# EAGLE schematic Resistor_Resistor (EAGLE 8.3.0), part 26 of 43
## Parts (continued)
R35798  10K  RESISTOR_0201  [0201]
R35799  10K  RESISTOR_0201  [0201]
R35800  10K  RESISTOR_0201  [0201]
R35801  10K  RESISTOR_0201  [0201]
R35802  10K  RESISTOR_0201  [0201]
R35803  10K  RESISTOR_0201  [0201]
R35804  10K  RESISTOR_0201  [0201]
R35805  10K  RESISTOR_0201  [0201]
R35806  10K  RESISTOR_0201  [0201]
R35807  10K  RESISTOR_0201  [0201]
R35808  10K  RESISTOR_0201  [0201]
R35809  10K  RESISTOR_0201  [0201]
R35810  10K  RESISTOR_0201  [0201]
R35811  10K  RESISTOR_0201  [0201]
R35812  10K  RESISTOR_0201  [0201]
R35813  10K  RESISTOR_0201  [0201]
R35814  10K  RESISTOR_0201  [0201]
R35815  10K  RESISTOR_0201  [0201]
R35816  10K  RESISTOR_0201  [0201]
R35817  10K  RESISTOR_0201  [0201]
R35818  10K  RESISTOR_0201  [0201]
R35819  10K  RESISTOR_0201  [0201]
R35820  10K  RESISTOR_0201  [0201]
R35821  10K  RESISTOR_0201  [0201]
R35822  10K  RESISTOR_0201  [0201]
R35823  10K  RESISTOR_0201  [0201]
R35824  10K  RESISTOR_0201  [0201]
R35825  10K  RESISTOR_0201  [0201]
R35826  10K  RESISTOR_0201  [0201]
R35827  10K  RESISTOR_0201  [0201]
R35828  10K  RESISTOR_0201  [0201]
R35829  10K  RESISTOR_0201  [0201]
R35830  10K  RESISTOR_0201  [0201]
R35831  10K  RESISTOR_0201  [0201]
R35832  10K  RESISTOR_0201  [0201]
R35833  10K  RESISTOR_0201  [0201]
R35834  10K  RESISTOR_0201  [0201]
R35835  10K  RESISTOR_0201  [0201]
R35836  10K  RESISTOR_0201  [0201]
R35837  10K  RESISTOR_0201  [0201]
R35838  10K  RESISTOR_0201  [0201]
R35839  10K  RESISTOR_0201  [0201]
R35840  10K  RESISTOR_0201  [0201]
R35841  10K  RESISTOR_0201  [0201]
R35842  10K  RESISTOR_0201  [0201]
R35843  10K  RESISTOR_0201  [0201]
R35844  10K  RESISTOR_0201  [0201]
R35845  10K  RESISTOR_0201  [0201]
R35846  10K  RESISTOR_0201  [0201]
R35847  10K  RESISTOR_0201  [0201]
R35848  10K  RESISTOR_0201  [0201]
R35849  10K  RESISTOR_0201  [0201]
R35850  10K  RESISTOR_0201  [0201]
R35851  10K  RESISTOR_0201  [0201]
R35852  10K  RESISTOR_0201  [0201]
R35853  10K  RESISTOR_0201  [0201]
R35854  10K  RESISTOR_0201  [0201]
R35855  10K  RESISTOR_0201  [0201]
R35856  10K  RESISTOR_0201  [0201]
R35857  10K  RESISTOR_0201  [0201]
R35858  10K  RESISTOR_0201  [0201]
R35859  10K  RESISTOR_0201  [0201]
R35860  10K  RESISTOR_0201  [0201]
R35861  10K  RESISTOR_0201  [0201]
R35862  10K  RESISTOR_0201  [0201]
R35863  10K  RESISTOR_0201  [0201]
R35864  10K  RESISTOR_0201  [0201]
R35865  10K  RESISTOR_0201  [0201]
R35866  10K  RESISTOR_0201  [0201]
R35867  10K  RESISTOR_0201  [0201]
R35868  10K  RESISTOR_0201  [0201]
R35869  10K  RESISTOR_0201  [0201]
R35870  10K  RESISTOR_0201  [0201]
R35871  10K  RESISTOR_0201  [0201]
R35872  10K  RESISTOR_0201  [0201]
R35873  10K  RESISTOR_0201  [0201]
R35874  10K  RESISTOR_0201  [0201]
R35875  10K  RESISTOR_0201  [0201]
R35876  10K  RESISTOR_0201  [0201]
R35877  10K  RESISTOR_0201  [0201]
R35878  10K  RESISTOR_0201  [0201]
R35879  10K  RESISTOR_0201  [0201]
R35880  10K  RESISTOR_0201  [0201]
R35881  10K  RESISTOR_0201  [0201]
R35882  10K  RESISTOR_0201  [0201]
R35883  10K  RESISTOR_0201  [0201]
R35884  10K  RESISTOR_0201  [0201]
R35885  10K  RESISTOR_0201  [0201]
R35886  10K  RESISTOR_0201  [0201]
R35887  10K  RESISTOR_0201  [0201]
R35888  10K  RESISTOR_0201  [0201]
R35889  10K  RESISTOR_0201  [0201]
R35890  10K  RESISTOR_0201  [0201]
R35891  10K  RESISTOR_0201  [0201]
R35892  10K  RESISTOR_0201  [0201]
R35893  10K  RESISTOR_0201  [0201]
R35894  10K  RESISTOR_0201  [0201]
R35895  10K  RESISTOR_0201  [0201]
R35896  10K  RESISTOR_0201  [0201]
R35897  10K  RESISTOR_0201  [0201]
R35898  10K  RESISTOR_0201  [0201]
R35899  10K  RESISTOR_0201  [0201]
R35900  10K  RESISTOR_0201  [0201]
R35901  10K  RESISTOR_0201  [0201]
R35902  10K  RESISTOR_0201  [0201]
R35903  10K  RESISTOR_0201  [0201]
R35904  10K  RESISTOR_0201  [0201]
R35905  10K  RESISTOR_0201  [0201]
R35906  10K  RESISTOR_0201  [0201]
R35907  10K  RESISTOR_0201  [0201]
R35908  10K  RESISTOR_0201  [0201]
R35909  10K  RESISTOR_0201  [0201]
R35910  10K  RESISTOR_0201  [0201]
R35911  10K  RESISTOR_0201  [0201]
R35912  10K  RESISTOR_0201  [0201]
R35913  10K  RESISTOR_0201  [0201]
R35914  10K  RESISTOR_0201  [0201]
R35915  10K  RESISTOR_0201  [0201]
R35916  10K  RESISTOR_0201  [0201]
R35917  10K  RESISTOR_0201  [0201]
R35918  10K  RESISTOR_0201  [0201]
R35919  10K  RESISTOR_0201  [0201]
R35920  10K  RESISTOR_0201  [0201]
R35921  10K  RESISTOR_0201  [0201]
R35922  10K  RESISTOR_0201  [0201]
R35923  10K  RESISTOR_0201  [0201]
R35924  10K  RESISTOR_0201  [0201]
R35925  10K  RESISTOR_0201  [0201]
R35926  10K  RESISTOR_0201  [0201]
R35927  10K  RESISTOR_0201  [0201]
R35928  10K  RESISTOR_0201  [0201]
R35929  10K  RESISTOR_0201  [0201]
R35930  10K  RESISTOR_0201  [0201]
R35931  10K  RESISTOR_0201  [0201]
R35932  10K  RESISTOR_0201  [0201]
R35933  10K  RESISTOR_0201  [0201]
R35934  10K  RESISTOR_0201  [0201]
R35935  10K  RESISTOR_0201  [0201]
R35936  10K  RESISTOR_0201  [0201]
R35937  10K  RESISTOR_0201  [0201]
R35938  10K  RESISTOR_0201  [0201]
R35939  10K  RESISTOR_0201  [0201]
R35940  10K  RESISTOR_0201  [0201]
R35941  10K  RESISTOR_0201  [0201]
R35942  10K  RESISTOR_0201  [0201]
R35943  10K  RESISTOR_0201  [0201]
R35944  10K  RESISTOR_0201  [0201]
R35945  10K  RESISTOR_0201  [0201]
R35946  10K  RESISTOR_0201  [0201]
R35947  10K  RESISTOR_0201  [0201]
R35948  10K  RESISTOR_0201  [0201]
R35949  10K  RESISTOR_0201  [0201]
R35950  10K  RESISTOR_0201  [0201]
R35951  10K  RESISTOR_0201  [0201]
R35952  10K  RESISTOR_0201  [0201]
R35953  10K  RESISTOR_0201  [0201]
R35954  10K  RESISTOR_0201  [0201]
R35955  10K  RESISTOR_0201  [0201]
R35956  10K  RESISTOR_0201  [0201]
R35957  10K  RESISTOR_0201  [0201]
R35958  10K  RESISTOR_0201  [0201]
R35959  10K  RESISTOR_0201  [0201]
R35960  10K  RESISTOR_0201  [0201]
R35961  10K  RESISTOR_0201  [0201]
R35962  10K  RESISTOR_0201  [0201]
R35963  10K  RESISTOR_0201  [0201]
R35964  10K  RESISTOR_0201  [0201]
R35965  10K  RESISTOR_0201  [0201]
R35966  10K  RESISTOR_0201  [0201]
R35967  10K  RESISTOR_0201  [0201]
R35968  10K  RESISTOR_0201  [0201]
R35969  10K  RESISTOR_0201  [0201]
R35970  10K  RESISTOR_0201  [0201]
R35971  10K  RESISTOR_0201  [0201]
R35972  10K  RESISTOR_0201  [0201]
R35973  10K  RESISTOR_0201  [0201]
R35974  10K  RESISTOR_0201  [0201]
R35975  10K  RESISTOR_0201  [0201]
R35976  10K  RESISTOR_0201  [0201]
R35977  10K  RESISTOR_0201  [0201]
R35978  10K  RESISTOR_0201  [0201]
R35979  10K  RESISTOR_0201  [0201]
R35980  10K  RESISTOR_0201  [0201]
R35981  10K  RESISTOR_0201  [0201]
R35982  10K  RESISTOR_0201  [0201]
R35983  10K  RESISTOR_0201  [0201]
R35984  10K  RESISTOR_0201  [0201]
R35985  10K  RESISTOR_0201  [0201]
R35986  10K  RESISTOR_0201  [0201]
R35987  10K  RESISTOR_0201  [0201]
R35988  10K  RESISTOR_0201  [0201]
R35989  10K  RESISTOR_0201  [0201]
R35990  10K  RESISTOR_0201  [0201]
R35991  10K  RESISTOR_0201  [0201]
R35992  10K  RESISTOR_0201  [0201]
R35993  10K  RESISTOR_0201  [0201]
R35994  10K  RESISTOR_0201  [0201]
R35995  10K  RESISTOR_0201  [0201]
R35996  10K  RESISTOR_0201  [0201]
R35997  10K  RESISTOR_0201  [0201]
R35998  10K  RESISTOR_0201  [0201]
R35999  10K  RESISTOR_0201  [0201]
R36000  10K  RESISTOR_0201  [0201]
R36001  10K  RESISTOR_0201  [0201]
R36002  10K  RESISTOR_0201  [0201]
R36003  10K  RESISTOR_0201  [0201]
R36004  10K  RESISTOR_0201  [0201]
R36005  10K  RESISTOR_0201  [0201]
R36006  10K  RESISTOR_0201  [0201]
R36007  10K  RESISTOR_0201  [0201]
R36008  10K  RESISTOR_0201  [0201]
R36009  10K  RESISTOR_0201  [0201]
R36010  10K  RESISTOR_0201  [0201]
R36011  10K  RESISTOR_0201  [0201]
R36012  10K  RESISTOR_0201  [0201]
R36013  10K  RESISTOR_0201  [0201]
R36014  10K  RESISTOR_0201  [0201]
R36015  10K  RESISTOR_0201  [0201]
R36016  10K  RESISTOR_0201  [0201]
R36017  10K  RESISTOR_0201  [0201]
R36018  10K  RESISTOR_0201  [0201]
R36019  10K  RESISTOR_0201  [0201]
R36020  10K  RESISTOR_0201  [0201]
R36021  10K  RESISTOR_0201  [0201]
R36022  10K  RESISTOR_0201  [0201]
R36023  10K  RESISTOR_0201  [0201]
R36024  10K  RESISTOR_0201  [0201]
R36025  10K  RESISTOR_0201  [0201]
R36026  10K  RESISTOR_0201  [0201]
R36027  10K  RESISTOR_0201  [0201]
R36028  10K  RESISTOR_0201  [0201]
R36029  10K  RESISTOR_0201  [0201]
R36030  10K  RESISTOR_0201  [0201]
R36031  10K  RESISTOR_0201  [0201]
R36032  10K  RESISTOR_0201  [0201]
R36033  10K  RESISTOR_0201  [0201]
R36034  10K  RESISTOR_0201  [0201]
R36035  10K  RESISTOR_0201  [0201]
R36036  10K  RESISTOR_0201  [0201]
R36037  10K  RESISTOR_0201  [0201]
R36038  10K  RESISTOR_0201  [0201]
R36039  10K  RESISTOR_0201  [0201]
R36040  10K  RESISTOR_0201  [0201]
R36041  10K  RESISTOR_0201  [0201]
R36042  10K  RESISTOR_0201  [0201]
R36043  10K  RESISTOR_0201  [0201]
R36044  10K  RESISTOR_0201  [0201]
R36045  10K  RESISTOR_0201  [0201]
R36046  10K  RESISTOR_0201  [0201]
R36047  10K  RESISTOR_0201  [0201]
R36048  10K  RESISTOR_0201  [0201]
R36049  10K  RESISTOR_0201  [0201]
R36050  10K  RESISTOR_0201  [0201]
R36051  10K  RESISTOR_0201  [0201]
R36052  10K  RESISTOR_0201  [0201]
R36053  10K  RESISTOR_0201  [0201]
R36054  10K  RESISTOR_0201  [0201]
R36055  10K  RESISTOR_0201  [0201]
R36056  10K  RESISTOR_0201  [0201]
R36057  10K  RESISTOR_0201  [0201]
R36058  10K  RESISTOR_0201  [0201]
R36059  10K  RESISTOR_0201  [0201]
R36060  10K  RESISTOR_0201  [0201]
R36061  10K  RESISTOR_0201  [0201]
R36062  10K  RESISTOR_0201  [0201]
R36063  10K  RESISTOR_0201  [0201]
R36064  10K  RESISTOR_0201  [0201]
R36065  10K  RESISTOR_0201  [0201]
R36066  10K  RESISTOR_0201  [0201]
R36067  10K  RESISTOR_0201  [0201]
R36068  10K  RESISTOR_0201  [0201]
R36069  10K  RESISTOR_0201  [0201]
R36070  10K  RESISTOR_0201  [0201]
R36071  10K  RESISTOR_0201  [0201]
R36072  10K  RESISTOR_0201  [0201]
R36073  10K  RESISTOR_0201  [0201]
R36074  10K  RESISTOR_0201  [0201]
R36075  10K  RESISTOR_0201  [0201]
R36076  10K  RESISTOR_0201  [0201]
R36077  10K  RESISTOR_0201  [0201]
R36078  10K  RESISTOR_0201  [0201]
R36079  10K  RESISTOR_0201  [0201]
R36080  10K  RESISTOR_0201  [0201]
R36081  10K  RESISTOR_0201  [0201]
R36082  10K  RESISTOR_0201  [0201]
R36083  10K  RESISTOR_0201  [0201]
R36084  10K  RESISTOR_0201  [0201]
R36085  10K  RESISTOR_0201  [0201]
R36086  10K  RESISTOR_0201  [0201]
R36087  10K  RESISTOR_0201  [0201]
R36088  10K  RESISTOR_0201  [0201]
R36089  10K  RESISTOR_0201  [0201]
R36090  10K  RESISTOR_0201  [0201]
R36091  10K  RESISTOR_0201  [0201]
R36092  10K  RESISTOR_0201  [0201]
R36093  10K  RESISTOR_0201  [0201]
R36094  10K  RESISTOR_0201  [0201]
R36095  10K  RESISTOR_0201  [0201]
R36096  10K  RESISTOR_0201  [0201]
R36097  10K  RESISTOR_0201  [0201]
R36098  10K  RESISTOR_0201  [0201]
R36099  10K  RESISTOR_0201  [0201]
R36100  10K  RESISTOR_0201  [0201]
R36101  10K  RESISTOR_0201  [0201]
R36102  10K  RESISTOR_0201  [0201]
R36103  10K  RESISTOR_0201  [0201]
R36104  10K  RESISTOR_0201  [0201]
R36105  10K  RESISTOR_0201  [0201]
R36106  10K  RESISTOR_0201  [0201]
R36107  10K  RESISTOR_0201  [0201]
R36108  10K  RESISTOR_0201  [0201]
R36109  10K  RESISTOR_0201  [0201]
R36110  10K  RESISTOR_0201  [0201]
R36111  10K  RESISTOR_0201  [0201]
R36112  10K  RESISTOR_0201  [0201]
R36113  10K  RESISTOR_0201  [0201]
R36114  10K  RESISTOR_0201  [0201]
R36115  10K  RESISTOR_0201  [0201]
R36116  10K  RESISTOR_0201  [0201]
R36117  10K  RESISTOR_0201  [0201]
R36118  10K  RESISTOR_0201  [0201]
R36119  10K  RESISTOR_0201  [0201]
R36120  10K  RESISTOR_0201  [0201]
R36121  10K  RESISTOR_0201  [0201]
R36122  10K  RESISTOR_0201  [0201]
R36123  10K  RESISTOR_0201  [0201]
R36124  10K  RESISTOR_0201  [0201]
R36125  10K  RESISTOR_0201  [0201]
R36126  10K  RESISTOR_0201  [0201]
R36127  10K  RESISTOR_0201  [0201]
R36128  10K  RESISTOR_0201  [0201]
R36129  10K  RESISTOR_0201  [0201]
R36130  10K  RESISTOR_0201  [0201]
R36131  10K  RESISTOR_0201  [0201]
R36132  10K  RESISTOR_0201  [0201]
R36133  10K  RESISTOR_0201  [0201]
R36134  10K  RESISTOR_0201  [0201]
R36135  10K  RESISTOR_0201  [0201]
R36136  10K  RESISTOR_0201  [0201]
R36137  10K  RESISTOR_0201  [0201]
R36138  10K  RESISTOR_0201  [0201]
R36139  10K  RESISTOR_0201  [0201]
R36140  10K  RESISTOR_0201  [0201]
R36141  10K  RESISTOR_0201  [0201]
R36142  10K  RESISTOR_0201  [0201]
R36143  10K  RESISTOR_0201  [0201]
R36144  10K  RESISTOR_0201  [0201]
R36145  10K  RESISTOR_0201  [0201]
R36146  10K  RESISTOR_0201  [0201]
R36147  10K  RESISTOR_0201  [0201]
R36148  10K  RESISTOR_0201  [0201]
R36149  10K  RESISTOR_0201  [0201]
R36150  10K  RESISTOR_0201  [0201]
R36151  10K  RESISTOR_0201  [0201]
R36152  10K  RESISTOR_0201  [0201]
R36153  10K  RESISTOR_0201  [0201]
R36154  10K  RESISTOR_0201  [0201]
R36155  10K  RESISTOR_0201  [0201]
R36156  10K  RESISTOR_0201  [0201]
R36157  10K  RESISTOR_0201  [0201]
R36158  10K  RESISTOR_0201  [0201]
R36159  10K  RESISTOR_0201  [0201]
R36160  10K  RESISTOR_0201  [0201]
R36161  10K  RESISTOR_0201  [0201]
R36162  10K  RESISTOR_0201  [0201]
R36163  10K  RESISTOR_0201  [0201]
R36164  10K  RESISTOR_0201  [0201]
R36165  10K  RESISTOR_0201  [0201]
R36166  10K  RESISTOR_0201  [0201]
R36167  10K  RESISTOR_0201  [0201]
R36168  10K  RESISTOR_0201  [0201]
R36169  10K  RESISTOR_0201  [0201]
R36170  10K  RESISTOR_0201  [0201]
R36171  10K  RESISTOR_0201  [0201]
R36172  10K  RESISTOR_0201  [0201]
R36173  10K  RESISTOR_0201  [0201]
R36174  10K  RESISTOR_0201  [0201]
R36175  10K  RESISTOR_0201  [0201]
R36176  10K  RESISTOR_0201  [0201]
R36177  10K  RESISTOR_0201  [0201]
R36178  10K  RESISTOR_0201  [0201]
R36179  10K  RESISTOR_0201  [0201]
R36180  10K  RESISTOR_0201  [0201]
R36181  10K  RESISTOR_0201  [0201]
R36182  10K  RESISTOR_0201  [0201]
R36183  10K  RESISTOR_0201  [0201]
R36184  10K  RESISTOR_0201  [0201]
R36185  10K  RESISTOR_0201  [0201]
R36186  10K  RESISTOR_0201  [0201]
R36187  10K  RESISTOR_0201  [0201]
R36188  10K  RESISTOR_0201  [0201]
R36189  10K  RESISTOR_0201  [0201]
R36190  10K  RESISTOR_0201  [0201]
R36191  10K  RESISTOR_0201  [0201]
R36192  10K  RESISTOR_0201  [0201]
R36193  10K  RESISTOR_0201  [0201]
R36194  10K  RESISTOR_0201  [0201]
R36195  10K  RESISTOR_0201  [0201]
R36196  10K  RESISTOR_0201  [0201]
R36197  10K  RESISTOR_0201  [0201]
R36198  10K  RESISTOR_0201  [0201]
R36199  10K  RESISTOR_0201  [0201]
R36200  10K  RESISTOR_0201  [0201]
R36201  10K  RESISTOR_0201  [0201]
R36202  10K  RESISTOR_0201  [0201]
R36203  10K  RESISTOR_0201  [0201]
R36204  10K  RESISTOR_0201  [0201]
R36205  10K  RESISTOR_0201  [0201]
R36206  10K  RESISTOR_0201  [0201]
R36207  10K  RESISTOR_0201  [0201]
R36208  10K  RESISTOR_0201  [0201]
R36209  10K  RESISTOR_0201  [0201]
R36210  10K  RESISTOR_0201  [0201]
R36211  10K  RESISTOR_0201  [0201]
R36212  10K  RESISTOR_0201  [0201]
R36213  10K  RESISTOR_0201  [0201]
R36214  10K  RESISTOR_0201  [0201]
R36215  10K  RESISTOR_0201  [0201]
R36216  10K  RESISTOR_0201  [0201]
R36217  10K  RESISTOR_0201  [0201]
R36218  10K  RESISTOR_0201  [0201]
R36219  10K  RESISTOR_0201  [0201]
R36220  10K  RESISTOR_0201  [0201]
R36221  10K  RESISTOR_0201  [0201]
R36222  10K  RESISTOR_0201  [0201]
R36223  10K  RESISTOR_0201  [0201]
R36224  10K  RESISTOR_0201  [0201]
R36225  10K  RESISTOR_0201  [0201]
R36226  10K  RESISTOR_0201  [0201]
R36227  10K  RESISTOR_0201  [0201]
R36228  10K  RESISTOR_0201  [0201]
R36229  10K  RESISTOR_0201  [0201]
R36230  10K  RESISTOR_0201  [0201]
R36231  10K  RESISTOR_0201  [0201]
R36232  10K  RESISTOR_0201  [0201]
R36233  10K  RESISTOR_0201  [0201]
R36234  10K  RESISTOR_0201  [0201]
R36235  10K  RESISTOR_0201  [0201]
R36236  10K  RESISTOR_0201  [0201]
R36237  10K  RESISTOR_0201  [0201]
R36238  10K  RESISTOR_0201  [0201]
R36239  10K  RESISTOR_0201  [0201]
R36240  10K  RESISTOR_0201  [0201]
R36241  10K  RESISTOR_0201  [0201]
R36242  10K  RESISTOR_0201  [0201]
R36243  10K  RESISTOR_0201  [0201]
R36244  10K  RESISTOR_0201  [0201]
R36245  10K  RESISTOR_0201  [0201]
R36246  10K  RESISTOR_0201  [0201]
R36247  10K  RESISTOR_0201  [0201]
R36248  10K  RESISTOR_0201  [0201]
R36249  10K  RESISTOR_0201  [0201]
R36250  10K  RESISTOR_0201  [0201]
R36251  10K  RESISTOR_0201  [0201]
R36252  10K  RESISTOR_0201  [0201]
R36253  10K  RESISTOR_0201  [0201]
R36254  10K  RESISTOR_0201  [0201]
R36255  10K  RESISTOR_0201  [0201]
R36256  10K  RESISTOR_0201  [0201]
R36257  10K  RESISTOR_0201  [0201]
R36258  10K  RESISTOR_0201  [0201]
R36259  10K  RESISTOR_0201  [0201]
R36260  10K  RESISTOR_0201  [0201]
R36261  10K  RESISTOR_0201  [0201]
R36262  10K  RESISTOR_0201  [0201]
R36263  10K  RESISTOR_0201  [0201]
R36264  10K  RESISTOR_0201  [0201]
R36265  10K  RESISTOR_0201  [0201]
R36266  10K  RESISTOR_0201  [0201]
R36267  10K  RESISTOR_0201  [0201]
R36268  10K  RESISTOR_0201  [0201]
R36269  10K  RESISTOR_0201  [0201]
R36270  10K  RESISTOR_0201  [0201]
R36271  10K  RESISTOR_0201  [0201]
R36272  10K  RESISTOR_0201  [0201]
R36273  10K  RESISTOR_0201  [0201]
R36274  10K  RESISTOR_0201  [0201]
R36275  10K  RESISTOR_0201  [0201]
R36276  10K  RESISTOR_0201  [0201]
R36277  10K  RESISTOR_0201  [0201]
R36278  10K  RESISTOR_0201  [0201]
R36279  10K  RESISTOR_0201  [0201]
R36280  10K  RESISTOR_0201  [0201]
R36281  10K  RESISTOR_0201  [0201]
R36282  10K  RESISTOR_0201  [0201]
R36283  10K  RESISTOR_0201  [0201]
R36284  10K  RESISTOR_0201  [0201]
R36285  10K  RESISTOR_0201  [0201]
R36286  10K  RESISTOR_0201  [0201]
R36287  10K  RESISTOR_0201  [0201]
R36288  10K  RESISTOR_0201  [0201]
R36289  10K  RESISTOR_0201  [0201]
R36290  10K  RESISTOR_0201  [0201]
R36291  10K  RESISTOR_0201  [0201]
R36292  10K  RESISTOR_0201  [0201]
R36293  10K  RESISTOR_0201  [0201]
R36294  10K  RESISTOR_0201  [0201]
R36295  10K  RESISTOR_0201  [0201]
R36296  10K  RESISTOR_0201  [0201]
R36297  10K  RESISTOR_0201  [0201]
R36298  10K  RESISTOR_0201  [0201]
R36299  10K  RESISTOR_0201  [0201]
R36300  10K  RESISTOR_0201  [0201]
R36301  10K  RESISTOR_0201  [0201]
R36302  10K  RESISTOR_0201  [0201]
R36303  10K  RESISTOR_0201  [0201]
R36304  10K  RESISTOR_0201  [0201]
R36305  10K  RESISTOR_0201  [0201]
R36306  10K  RESISTOR_0201  [0201]
R36307  10K  RESISTOR_0201  [0201]
R36308  10K  RESISTOR_0201  [0201]
R36309  10K  RESISTOR_0201  [0201]
R36310  10K  RESISTOR_0201  [0201]
R36311  10K  RESISTOR_0201  [0201]
R36312  10K  RESISTOR_0201  [0201]
R36313  10K  RESISTOR_0201  [0201]
R36314  10K  RESISTOR_0201  [0201]
R36315  10K  RESISTOR_0201  [0201]
R36316  10K  RESISTOR_0201  [0201]
R36317  10K  RESISTOR_0201  [0201]
R36318  10K  RESISTOR_0201  [0201]
R36319  10K  RESISTOR_0201  [0201]
R36320  10K  RESISTOR_0201  [0201]
R36321  10K  RESISTOR_0201  [0201]
R36322  10K  RESISTOR_0201  [0201]
R36323  10K  RESISTOR_0201  [0201]
R36324  10K  RESISTOR_0201  [0201]
R36325  10K  RESISTOR_0201  [0201]
R36326  10K  RESISTOR_0201  [0201]
R36327  10K  RESISTOR_0201  [0201]
R36328  10K  RESISTOR_0201  [0201]
R36329  10K  RESISTOR_0201  [0201]
R36330  10K  RESISTOR_0201  [0201]
R36331  10K  RESISTOR_0201  [0201]
R36332  10K  RESISTOR_0201  [0201]
R36333  10K  RESISTOR_0201  [0201]
R36334  10K  RESISTOR_0201  [0201]
R36335  10K  RESISTOR_0201  [0201]
R36336  10K  RESISTOR_0201  [0201]
R36337  10K  RESISTOR_0201  [0201]
R36338  10K  RESISTOR_0201  [0201]
R36339  10K  RESISTOR_0201  [0201]
R36340  10K  RESISTOR_0201  [0201]
R36341  10K  RESISTOR_0201  [0201]
R36342  10K  RESISTOR_0201  [0201]
R36343  10K  RESISTOR_0201  [0201]
R36344  10K  RESISTOR_0201  [0201]
R36345  10K  RESISTOR_0201  [0201]
R36346  10K  RESISTOR_0201  [0201]
R36347  10K  RESISTOR_0201  [0201]
R36348  10K  RESISTOR_0201  [0201]
R36349  10K  RESISTOR_0201  [0201]
R36350  10K  RESISTOR_0201  [0201]
R36351  10K  RESISTOR_0201  [0201]
R36352  10K  RESISTOR_0201  [0201]
R36353  10K  RESISTOR_0201  [0201]
R36354  10K  RESISTOR_0201  [0201]
R36355  10K  RESISTOR_0201  [0201]
R36356  10K  RESISTOR_0201  [0201]
R36357  10K  RESISTOR_0201  [0201]
R36358  10K  RESISTOR_0201  [0201]
R36359  10K  RESISTOR_0201  [0201]
R36360  10K  RESISTOR_0201  [0201]
R36361  10K  RESISTOR_0201  [0201]
R36362  10K  RESISTOR_0201  [0201]
R36363  10K  RESISTOR_0201  [0201]
R36364  10K  RESISTOR_0201  [0201]
R36365  10K  RESISTOR_0201  [0201]
R36366  10K  RESISTOR_0201  [0201]
R36367  10K  RESISTOR_0201  [0201]
R36368  10K  RESISTOR_0201  [0201]
R36369  10K  RESISTOR_0201  [0201]
R36370  10K  RESISTOR_0201  [0201]
R36371  10K  RESISTOR_0201  [0201]
R36372  10K  RESISTOR_0201  [0201]
R36373  10K  RESISTOR_0201  [0201]
R36374  10K  RESISTOR_0201  [0201]
R36375  10K  RESISTOR_0201  [0201]
R36376  10K  RESISTOR_0201  [0201]
R36377  10K  RESISTOR_0201  [0201]
R36378  10K  RESISTOR_0201  [0201]
R36379  10K  RESISTOR_0201  [0201]
R36380  10K  RESISTOR_0201  [0201]
R36381  10K  RESISTOR_0201  [0201]
R36382  10K  RESISTOR_0201  [0201]
R36383  10K  RESISTOR_0201  [0201]
R36384  10K  RESISTOR_0201  [0201]
R36385  10K  RESISTOR_0201  [0201]
R36386  10K  RESISTOR_0201  [0201]
R36387  10K  RESISTOR_0201  [0201]
R36388  10K  RESISTOR_0201  [0201]
R36389  10K  RESISTOR_0201  [0201]
R36390  10K  RESISTOR_0201  [0201]
R36391  10K  RESISTOR_0201  [0201]
R36392  10K  RESISTOR_0201  [0201]
R36393  10K  RESISTOR_0201  [0201]
R36394  10K  RESISTOR_0201  [0201]
R36395  10K  RESISTOR_0201  [0201]
R36396  10K  RESISTOR_0201  [0201]
R36397  10K  RESISTOR_0201  [0201]
R36398  10K  RESISTOR_0201  [0201]
R36399  10K  RESISTOR_0201  [0201]
R36400  10K  RESISTOR_0201  [0201]
R36401  10K  RESISTOR_0201  [0201]
R36402  10K  RESISTOR_0201  [0201]
R36403  10K  RESISTOR_0201  [0201]
R36404  10K  RESISTOR_0201  [0201]
R36405  10K  RESISTOR_0201  [0201]
R36406  10K  RESISTOR_0201  [0201]
R36407  10K  RESISTOR_0201  [0201]
R36408  10K  RESISTOR_0201  [0201]
R36409  10K  RESISTOR_0201  [0201]
R36410  10K  RESISTOR_0201  [0201]
R36411  10K  RESISTOR_0201  [0201]
R36412  10K  RESISTOR_0201  [0201]
R36413  10K  RESISTOR_0201  [0201]
R36414  10K  RESISTOR_0201  [0201]
R36415  10K  RESISTOR_0201  [0201]
R36416  10K  RESISTOR_0201  [0201]
R36417  10K  RESISTOR_0201  [0201]
R36418  10K  RESISTOR_0201  [0201]
R36419  10K  RESISTOR_0201  [0201]
R36420  10K  RESISTOR_0201  [0201]
R36421  10K  RESISTOR_0201  [0201]
R36422  10K  RESISTOR_0201  [0201]
R36423  10K  RESISTOR_0201  [0201]
R36424  10K  RESISTOR_0201  [0201]
R36425  10K  RESISTOR_0201  [0201]
R36426  10K  RESISTOR_0201  [0201]
R36427  10K  RESISTOR_0201  [0201]
R36428  10K  RESISTOR_0201  [0201]
R36429  10K  RESISTOR_0201  [0201]
R36430  10K  RESISTOR_0201  [0201]
R36431  10K  RESISTOR_0201  [0201]
R36432  10K  RESISTOR_0201  [0201]
R36433  10K  RESISTOR_0201  [0201]
R36434  10K  RESISTOR_0201  [0201]
R36435  10K  RESISTOR_0201  [0201]
R36436  10K  RESISTOR_0201  [0201]
R36437  10K  RESISTOR_0201  [0201]
R36438  10K  RESISTOR_0201  [0201]
R36439  10K  RESISTOR_0201  [0201]
R36440  10K  RESISTOR_0201  [0201]
R36441  10K  RESISTOR_0201  [0201]
R36442  10K  RESISTOR_0201  [0201]
R36443  10K  RESISTOR_0201  [0201]
R36444  10K  RESISTOR_0201  [0201]
R36445  10K  RESISTOR_0201  [0201]
R36446  10K  RESISTOR_0201  [0201]
R36447  10K  RESISTOR_0201  [0201]
R36448  10K  RESISTOR_0201  [0201]
R36449  10K  RESISTOR_0201  [0201]
R36450  10K  RESISTOR_0201  [0201]
R36451  10K  RESISTOR_0201  [0201]
R36452  10K  RESISTOR_0201  [0201]
R36453  10K  RESISTOR_0201  [0201]
R36454  10K  RESISTOR_0201  [0201]
R36455  10K  RESISTOR_0201  [0201]
R36456  10K  RESISTOR_0201  [0201]
R36457  10K  RESISTOR_0201  [0201]
R36458  10K  RESISTOR_0201  [0201]
R36459  10K  RESISTOR_0201  [0201]
R36460  10K  RESISTOR_0201  [0201]
R36461  10K  RESISTOR_0201  [0201]
R36462  10K  RESISTOR_0201  [0201]
R36463  10K  RESISTOR_0201  [0201]
R36464  10K  RESISTOR_0201  [0201]
R36465  10K  RESISTOR_0201  [0201]
R36466  10K  RESISTOR_0201  [0201]
R36467  10K  RESISTOR_0201  [0201]
R36468  10K  RESISTOR_0201  [0201]
R36469  10K  RESISTOR_0201  [0201]
R36470  10K  RESISTOR_0201  [0201]
R36471  10K  RESISTOR_0201  [0201]
R36472  10K  RESISTOR_0201  [0201]
R36473  10K  RESISTOR_0201  [0201]
R36474  10K  RESISTOR_0201  [0201]
R36475  10K  RESISTOR_0201  [0201]
R36476  10K  RESISTOR_0201  [0201]
R36477  10K  RESISTOR_0201  [0201]
R36478  10K  RESISTOR_0201  [0201]
R36479  10K  RESISTOR_0201  [0201]
R36480  10K  RESISTOR_0201  [0201]
R36481  10K  RESISTOR_0201  [0201]
R36482  10K  RESISTOR_0201  [0201]
R36483  10K  RESISTOR_0201  [0201]
R36484  10K  RESISTOR_0201  [0201]
R36485  10K  RESISTOR_0201  [0201]
R36486  10K  RESISTOR_0201  [0201]
R36487  10K  RESISTOR_0201  [0201]
R36488  10K  RESISTOR_0201  [0201]
R36489  10K  RESISTOR_0201  [0201]
R36490  10K  RESISTOR_0201  [0201]
R36491  10K  RESISTOR_0201  [0201]
R36492  10K  RESISTOR_0201  [0201]
R36493  10K  RESISTOR_0201  [0201]
R36494  10K  RESISTOR_0201  [0201]
R36495  10K  RESISTOR_0201  [0201]
R36496  10K  RESISTOR_0201  [0201]
R36497  10K  RESISTOR_0201  [0201]
R36498  10K  RESISTOR_0201  [0201]
R36499  10K  RESISTOR_0201  [0201]
R36500  10K  RESISTOR_0201  [0201]
R36501  10K  RESISTOR_0201  [0201]
R36502  10K  RESISTOR_0201  [0201]
R36503  10K  RESISTOR_0201  [0201]
R36504  10K  RESISTOR_0201  [0201]
R36505  10K  RESISTOR_0201  [0201]
R36506  10K  RESISTOR_0201  [0201]
R36507  10K  RESISTOR_0201  [0201]
R36508  10K  RESISTOR_0201  [0201]
R36509  10K  RESISTOR_0201  [0201]
R36510  10K  RESISTOR_0201  [0201]
R36511  10K  RESISTOR_0201  [0201]
R36512  10K  RESISTOR_0201  [0201]
R36513  10K  RESISTOR_0201  [0201]
R36514  10K  RESISTOR_0201  [0201]
R36515  10K  RESISTOR_0201  [0201]
R36516  10K  RESISTOR_0201  [0201]
R36517  10K  RESISTOR_0201  [0201]
R36518  10K  RESISTOR_0201  [0201]
R36519  10K  RESISTOR_0201  [0201]
R36520  10K  RESISTOR_0201  [0201]
R36521  10K  RESISTOR_0201  [0201]
R36522  10K  RESISTOR_0201  [0201]
R36523  10K  RESISTOR_0201  [0201]
R36524  10K  RESISTOR_0201  [0201]
R36525  10K  RESISTOR_0201  [0201]
R36526  10K  RESISTOR_0201  [0201]
R36527  10K  RESISTOR_0201  [0201]
R36528  10K  RESISTOR_0201  [0201]
R36529  10K  RESISTOR_0201  [0201]
R36530  10K  RESISTOR_0201  [0201]
R36531  10K  RESISTOR_0201  [0201]
R36532  10K  RESISTOR_0201  [0201]
R36533  10K  RESISTOR_0201  [0201]
R36534  10K  RESISTOR_0201  [0201]
R36535  10K  RESISTOR_0201  [0201]
R36536  10K  RESISTOR_0201  [0201]
R36537  10K  RESISTOR_0201  [0201]
R36538  10K  RESISTOR_0201  [0201]
R36539  10K  RESISTOR_0201  [0201]
R36540  10K  RESISTOR_0201  [0201]
R36541  10K  RESISTOR_0201  [0201]
R36542  10K  RESISTOR_0201  [0201]
R36543  10K  RESISTOR_0201  [0201]
R36544  10K  RESISTOR_0201  [0201]
R36545  10K  RESISTOR_0201  [0201]
R36546  10K  RESISTOR_0201  [0201]
R36547  10K  RESISTOR_0201  [0201]
R36548  10K  RESISTOR_0201  [0201]
R36549  10K  RESISTOR_0201  [0201]
R36550  10K  RESISTOR_0201  [0201]
R36551  10K  RESISTOR_0201  [0201]
R36552  10K  RESISTOR_0201  [0201]
R36553  10K  RESISTOR_0201  [0201]
R36554  10K  RESISTOR_0201  [0201]
R36555  10K  RESISTOR_0201  [0201]
R36556  10K  RESISTOR_0201  [0201]
R36557  10K  RESISTOR_0201  [0201]
R36558  10K  RESISTOR_0201  [0201]
R36559  10K  RESISTOR_0201  [0201]
R36560  10K  RESISTOR_0201  [0201]
R36561  10K  RESISTOR_0201  [0201]
R36562  10K  RESISTOR_0201  [0201]
R36563  10K  RESISTOR_0201  [0201]
R36564  10K  RESISTOR_0201  [0201]
R36565  10K  RESISTOR_0201  [0201]
R36566  10K  RESISTOR_0201  [0201]
R36567  10K  RESISTOR_0201  [0201]
R36568  10K  RESISTOR_0201  [0201]
R36569  10K  RESISTOR_0201  [0201]
R36570  10K  RESISTOR_0201  [0201]
R36571  10K  RESISTOR_0201  [0201]
R36572  10K  RESISTOR_0201  [0201]
R36573  10K  RESISTOR_0201  [0201]
R36574  10K  RESISTOR_0201  [0201]
R36575  10K  RESISTOR_0201  [0201]
R36576  10K  RESISTOR_0201  [0201]
R36577  10K  RESISTOR_0201  [0201]
R36578  10K  RESISTOR_0201  [0201]
R36579  10K  RESISTOR_0201  [0201]
R36580  10K  RESISTOR_0201  [0201]
R36581  10K  RESISTOR_0201  [0201]
R36582  10K  RESISTOR_0201  [0201]
R36583  10K  RESISTOR_0201  [0201]
R36584  10K  RESISTOR_0201  [0201]
R36585  10K  RESISTOR_0201  [0201]
R36586  10K  RESISTOR_0201  [0201]
R36587  10K  RESISTOR_0201  [0201]
R36588  10K  RESISTOR_0201  [0201]
R36589  10K  RESISTOR_0201  [0201]
R36590  10K  RESISTOR_0201  [0201]
R36591  10K  RESISTOR_0201  [0201]
R36592  10K  RESISTOR_0201  [0201]
R36593  10K  RESISTOR_0201  [0201]
R36594  10K  RESISTOR_0201  [0201]
R36595  10K  RESISTOR_0201  [0201]
R36596  10K  RESISTOR_0201  [0201]
R36597  10K  RESISTOR_0201  [0201]
R36598  10K  RESISTOR_0201  [0201]
R36599  10K  RESISTOR_0201  [0201]
R36600  10K  RESISTOR_0201  [0201]
R36601  10K  RESISTOR_0201  [0201]
R36602  10K  RESISTOR_0201  [0201]
R36603  10K  RESISTOR_0201  [0201]
R36604  10K  RESISTOR_0201  [0201]
R36605  10K  RESISTOR_0201  [0201]
R36606  10K  RESISTOR_0201  [0201]
R36607  10K  RESISTOR_0201  [0201]
R36608  10K  RESISTOR_0201  [0201]
R36609  10K  RESISTOR_0201  [0201]
R36610  10K  RESISTOR_0201  [0201]
R36611  10K  RESISTOR_0201  [0201]
R36612  10K  RESISTOR_0201  [0201]
R36613  10K  RESISTOR_0201  [0201]
R36614  10K  RESISTOR_0201  [0201]
R36615  10K  RESISTOR_0201  [0201]
R36616  10K  RESISTOR_0201  [0201]
R36617  10K  RESISTOR_0201  [0201]
R36618  10K  RESISTOR_0201  [0201]
R36619  10K  RESISTOR_0201  [0201]
R36620  10K  RESISTOR_0201  [0201]
R36621  10K  RESISTOR_0201  [0201]
R36622  10K  RESISTOR_0201  [0201]
R36623  10K  RESISTOR_0201  [0201]
R36624  10K  RESISTOR_0201  [0201]
R36625  10K  RESISTOR_0201  [0201]
R36626  10K  RESISTOR_0201  [0201]
R36627  10K  RESISTOR_0201  [0201]
R36628  10K  RESISTOR_0201  [0201]
R36629  10K  RESISTOR_0201  [0201]
R36630  10K  RESISTOR_0201  [0201]
R36631  10K  RESISTOR_0201  [0201]
R36632  10K  RESISTOR_0201  [0201]
R36633  10K  RESISTOR_0201  [0201]
R36634  10K  RESISTOR_0201  [0201]
R36635  10K  RESISTOR_0201  [0201]
R36636  10K  RESISTOR_0201  [0201]
R36637  10K  RESISTOR_0201  [0201]
R36638  10K  RESISTOR_0201  [0201]
R36639  10K  RESISTOR_0201  [0201]
R36640  10K  RESISTOR_0201  [0201]
R36641  10K  RESISTOR_0201  [0201]
R36642  10K  RESISTOR_0201  [0201]
R36643  10K  RESISTOR_0201  [0201]
R36644  10K  RESISTOR_0201  [0201]
R36645  10K  RESISTOR_0201  [0201]
R36646  10K  RESISTOR_0201  [0201]
R36647  10K  RESISTOR_0201  [0201]
R36648  10K  RESISTOR_0201  [0201]
R36649  10K  RESISTOR_0201  [0201]
R36650  10K  RESISTOR_0201  [0201]
R36651  10K  RESISTOR_0201  [0201]
R36652  10K  RESISTOR_0201  [0201]
R36653  10K  RESISTOR_0201  [0201]
R36654  10K  RESISTOR_0201  [0201]
R36655  10K  RESISTOR_0201  [0201]
R36656  10K  RESISTOR_0201  [0201]
R36657  10K  RESISTOR_0201  [0201]
R36658  10K  RESISTOR_0201  [0201]
R36659  10K  RESISTOR_0201  [0201]
R36660  10K  RESISTOR_0201  [0201]
R36661  10K  RESISTOR_0201  [0201]
R36662  10K  RESISTOR_0201  [0201]
R36663  10K  RESISTOR_0201  [0201]
R36664  10K  RESISTOR_0201  [0201]
R36665  10K  RESISTOR_0201  [0201]
R36666  10K  RESISTOR_0201  [0201]
R36667  10K  RESISTOR_0201  [0201]
R36668  10K  RESISTOR_0201  [0201]
R36669  10K  RESISTOR_0201  [0201]
R36670  10K  RESISTOR_0201  [0201]
R36671  10K  RESISTOR_0201  [0201]
R36672  10K  RESISTOR_0201  [0201]
R36673  10K  RESISTOR_0201  [0201]
R36674  10K  RESISTOR_0201  [0201]
R36675  10K  RESISTOR_0201  [0201]
R36676  10K  RESISTOR_0201  [0201]
R36677  10K  RESISTOR_0201  [0201]
R36678  10K  RESISTOR_0201  [0201]
R36679  10K  RESISTOR_0201  [0201]
R36680  10K  RESISTOR_0201  [0201]
R36681  10K  RESISTOR_0201  [0201]
R36682  10K  RESISTOR_0201  [0201]
R36683  10K  RESISTOR_0201  [0201]
R36684  10K  RESISTOR_0201  [0201]
R36685  10K  RESISTOR_0201  [0201]
R36686  10K  RESISTOR_0201  [0201]
R36687  10K  RESISTOR_0201  [0201]
R36688  10K  RESISTOR_0201  [0201]
R36689  10K  RESISTOR_0201  [0201]
R36690  10K  RESISTOR_0201  [0201]
R36691  10K  RESISTOR_0201  [0201]
R36692  10K  RESISTOR_0201  [0201]
R36693  10K  RESISTOR_0201  [0201]
R36694  10K  RESISTOR_0201  [0201]
R36695  10K  RESISTOR_0201  [0201]
R36696  10K  RESISTOR_0201  [0201]
R36697  10K  RESISTOR_0201  [0201]
R36698  10K  RESISTOR_0201  [0201]
R36699  10K  RESISTOR_0201  [0201]
R36700  10K  RESISTOR_0201  [0201]
R36701  10K  RESISTOR_0201  [0201]
R36702  10K  RESISTOR_0201  [0201]
R36703  10K  RESISTOR_0201  [0201]
R36704  10K  RESISTOR_0201  [0201]
R36705  10K  RESISTOR_0201  [0201]
R36706  10K  RESISTOR_0201  [0201]
R36707  10K  RESISTOR_0201  [0201]
R36708  10K  RESISTOR_0201  [0201]
R36709  10K  RESISTOR_0201  [0201]
R36710  10K  RESISTOR_0201  [0201]
R36711  10K  RESISTOR_0201  [0201]
R36712  10K  RESISTOR_0201  [0201]
R36713  10K  RESISTOR_0201  [0201]
R36714  10K  RESISTOR_0201  [0201]
R36715  10K  RESISTOR_0201  [0201]
R36716  10K  RESISTOR_0201  [0201]
R36717  10K  RESISTOR_0201  [0201]
R36718  10K  RESISTOR_0201  [0201]
R36719  10K  RESISTOR_0201  [0201]
R36720  10K  RESISTOR_0201  [0201]
R36721  10K  RESISTOR_0201  [0201]
R36722  10K  RESISTOR_0201  [0201]
R36723  10K  RESISTOR_0201  [0201]
R36724  10K  RESISTOR_0201  [0201]
R36725  10K  RESISTOR_0201  [0201]
R36726  10K  RESISTOR_0201  [0201]
R36727  10K  RESISTOR_0201  [0201]
R36728  10K  RESISTOR_0201  [0201]
R36729  10K  RESISTOR_0201  [0201]
R36730  10K  RESISTOR_0201  [0201]
R36731  10K  RESISTOR_0201  [0201]
R36732  10K  RESISTOR_0201  [0201]
R36733  10K  RESISTOR_0201  [0201]
R36734  10K  RESISTOR_0201  [0201]
R36735  10K  RESISTOR_0201  [0201]
R36736  10K  RESISTOR_0201  [0201]
R36737  10K  RESISTOR_0201  [0201]
R36738  10K  RESISTOR_0201  [0201]
R36739  10K  RESISTOR_0201  [0201]
R36740  10K  RESISTOR_0201  [0201]
R36741  10K  RESISTOR_0201  [0201]
R36742  10K  RESISTOR_0201  [0201]
R36743  10K  RESISTOR_0201  [0201]
R36744  10K  RESISTOR_0201  [0201]
R36745  10K  RESISTOR_0201  [0201]
R36746  10K  RESISTOR_0201  [0201]
R36747  10K  RESISTOR_0201  [0201]
R36748  10K  RESISTOR_0201  [0201]
R36749  10K  RESISTOR_0201  [0201]
R36750  10K  RESISTOR_0201  [0201]
R36751  10K  RESISTOR_0201  [0201]
R36752  10K  RESISTOR_0201  [0201]
R36753  10K  RESISTOR_0201  [0201]
R36754  10K  RESISTOR_0201  [0201]
R36755  10K  RESISTOR_0201  [0201]
R36756  10K  RESISTOR_0201  [0201]
R36757  10K  RESISTOR_0201  [0201]
R36758  10K  RESISTOR_0201  [0201]
R36759  10K  RESISTOR_0201  [0201]
R36760  10K  RESISTOR_0201  [0201]
R36761  10K  RESISTOR_0201  [0201]
R36762  10K  RESISTOR_0201  [0201]
R36763  10K  RESISTOR_0201  [0201]
R36764  10K  RESISTOR_0201  [0201]
R36765  10K  RESISTOR_0201  [0201]
R36766  10K  RESISTOR_0201  [0201]
R36767  10K  RESISTOR_0201  [0201]
R36768  10K  RESISTOR_0201  [0201]
R36769  10K  RESISTOR_0201  [0201]
R36770  10K  RESISTOR_0201  [0201]
R36771  10K  RESISTOR_0201  [0201]
R36772  10K  RESISTOR_0201  [0201]
R36773  10K  RESISTOR_0201  [0201]
R36774  10K  RESISTOR_0201  [0201]
R36775  10K  RESISTOR_0201  [0201]
R36776  10K  RESISTOR_0201  [0201]
R36777  10K  RESISTOR_0201  [0201]
R36778  10K  RESISTOR_0201  [0201]
R36779  10K  RESISTOR_0201  [0201]
R36780  10K  RESISTOR_0201  [0201]
R36781  10K  RESISTOR_0201  [0201]
R36782  10K  RESISTOR_0201  [0201]
R36783  10K  RESISTOR_0201  [0201]
R36784  10K  RESISTOR_0201  [0201]
R36785  10K  RESISTOR_0201  [0201]
R36786  10K  RESISTOR_0201  [0201]
R36787  10K  RESISTOR_0201  [0201]
R36788  10K  RESISTOR_0201  [0201]
R36789  10K  RESISTOR_0201  [0201]
R36790  10K  RESISTOR_0201  [0201]
R36791  10K  RESISTOR_0201  [0201]
R36792  10K  RESISTOR_0201  [0201]
R36793  10K  RESISTOR_0201  [0201]
R36794  10K  RESISTOR_0201  [0201]
R36795  10K  RESISTOR_0201  [0201]
R36796  10K  RESISTOR_0201  [0201]
R36797  10K  RESISTOR_0201  [0201]
R36798  10K  RESISTOR_0201  [0201]
R36799  10K  RESISTOR_0201  [0201]
R36800  10K  RESISTOR_0201  [0201]
R36801  10K  RESISTOR_0201  [0201]
R36802  10K  RESISTOR_0201  [0201]
R36803  10K  RESISTOR_0201  [0201]
R36804  10K  RESISTOR_0201  [0201]
R36805  10K  RESISTOR_0201  [0201]
R36806  10K  RESISTOR_0201  [0201]
R36807  10K  RESISTOR_0201  [0201]
R36808  10K  RESISTOR_0201  [0201]
R36809  10K  RESISTOR_0201  [0201]
R36810  10K  RESISTOR_0201  [0201]
R36811  10K  RESISTOR_0201  [0201]
R36812  10K  RESISTOR_0201  [0201]
R36813  10K  RESISTOR_0201  [0201]
R36814  10K  RESISTOR_0201  [0201]
R36815  10K  RESISTOR_0201  [0201]
R36816  10K  RESISTOR_0201  [0201]
R36817  10K  RESISTOR_0201  [0201]
R36818  10K  RESISTOR_0201  [0201]
R36819  10K  RESISTOR_0201  [0201]
R36820  10K  RESISTOR_0201  [0201]
R36821  10K  RESISTOR_0201  [0201]
R36822  10K  RESISTOR_0201  [0201]
R36823  10K  RESISTOR_0201  [0201]
R36824  10K  RESISTOR_0201  [0201]
R36825  10K  RESISTOR_0201  [0201]
R36826  10K  RESISTOR_0201  [0201]
R36827  10K  RESISTOR_0201  [0201]
R36828  10K  RESISTOR_0201  [0201]
R36829  10K  RESISTOR_0201  [0201]
R36830  10K  RESISTOR_0201  [0201]
R36831  10K  RESISTOR_0201  [0201]
R36832  10K  RESISTOR_0201  [0201]
R36833  10K  RESISTOR_0201  [0201]
R36834  10K  RESISTOR_0201  [0201]
R36835  10K  RESISTOR_0201  [0201]
R36836  10K  RESISTOR_0201  [0201]
R36837  10K  RESISTOR_0201  [0201]
R36838  10K  RESISTOR_0201  [0201]
R36839  10K  RESISTOR_0201  [0201]
R36840  10K  RESISTOR_0201  [0201]
R36841  10K  RESISTOR_0201  [0201]
R36842  10K  RESISTOR_0201  [0201]
R36843  10K  RESISTOR_0201  [0201]
R36844  10K  RESISTOR_0201  [0201]
R36845  10K  RESISTOR_0201  [0201]
R36846  10K  RESISTOR_0201  [0201]
R36847  10K  RESISTOR_0201  [0201]
R36848  10K  RESISTOR_0201  [0201]
R36849  10K  RESISTOR_0201  [0201]
R36850  10K  RESISTOR_0201  [0201]
R36851  10K  RESISTOR_0201  [0201]
R36852  10K  RESISTOR_0201  [0201]
R36853  10K  RESISTOR_0201  [0201]
R36854  10K  RESISTOR_0201  [0201]
R36855  10K  RESISTOR_0201  [0201]
R36856  10K  RESISTOR_0201  [0201]
R36857  10K  RESISTOR_0201  [0201]
R36858  10K  RESISTOR_0201  [0201]
R36859  10K  RESISTOR_0201  [0201]
R36860  10K  RESISTOR_0201  [0201]
R36861  10K  RESISTOR_0201  [0201]
R36862  10K  RESISTOR_0201  [0201]
R36863  10K  RESISTOR_0201  [0201]
R36864  10K  RESISTOR_0201  [0201]
R36865  10K  RESISTOR_0201  [0201]
R36866  10K  RESISTOR_0201  [0201]
R36867  10K  RESISTOR_0201  [0201]
R36868  10K  RESISTOR_0201  [0201]
R36869  10K  RESISTOR_0201  [0201]
R36870  10K  RESISTOR_0201  [0201]
R36871  10K  RESISTOR_0201  [0201]
R36872  10K  RESISTOR_0201  [0201]
R36873  10K  RESISTOR_0201  [0201]
R36874  10K  RESISTOR_0201  [0201]
R36875  10K  RESISTOR_0201  [0201]
R36876  10K  RESISTOR_0201  [0201]
R36877  10K  RESISTOR_0201  [0201]
R36878  10K  RESISTOR_0201  [0201]
R36879  10K  RESISTOR_0201  [0201]
R36880  10K  RESISTOR_0201  [0201]
R36881  10K  RESISTOR_0201  [0201]
R36882  10K  RESISTOR_0201  [0201]
R36883  10K  RESISTOR_0201  [0201]
R36884  10K  RESISTOR_0201  [0201]
R36885  10K  RESISTOR_0201  [0201]
R36886  10K  RESISTOR_0201  [0201]
R36887  10K  RESISTOR_0201  [0201]
R36888  10K  RESISTOR_0201  [0201]
R36889  10K  RESISTOR_0201  [0201]
R36890  10K  RESISTOR_0201  [0201]
R36891  10K  RESISTOR_0201  [0201]
R36892  10K  RESISTOR_0201  [0201]
R36893  10K  RESISTOR_0201  [0201]
R36894  10K  RESISTOR_0201  [0201]
R36895  10K  RESISTOR_0201  [0201]
R36896  10K  RESISTOR_0201  [0201]
R36897  10K  RESISTOR_0201  [0201]
R36898  10K  RESISTOR_0201  [0201]
R36899  10K  RESISTOR_0201  [0201]
R36900  10K  RESISTOR_0201  [0201]
R36901  10K  RESISTOR_0201  [0201]
R36902  10K  RESISTOR_0201  [0201]
R36903  10K  RESISTOR_0201  [0201]
R36904  10K  RESISTOR_0201  [0201]
R36905  10K  RESISTOR_0201  [0201]
R36906  10K  RESISTOR_0201  [0201]
R36907  10K  RESISTOR_0201  [0201]
R36908  10K  RESISTOR_0201  [0201]
R36909  10K  RESISTOR_0201  [0201]
R36910  10K  RESISTOR_0201  [0201]
R36911  10K  RESISTOR_0201  [0201]
R36912  10K  RESISTOR_0201  [0201]
R36913  10K  RESISTOR_0201  [0201]
R36914  10K  RESISTOR_0201  [0201]
R36915  10K  RESISTOR_0201  [0201]
R36916  10K  RESISTOR_0201  [0201]
R36917  10K  RESISTOR_0201  [0201]
R36918  10K  RESISTOR_0201  [0201]
R36919  10K  RESISTOR_0201  [0201]
R36920  10K  RESISTOR_0201  [0201]
R36921  10K  RESISTOR_0201  [0201]
R36922  10K  RESISTOR_0201  [0201]
R36923  10K  RESISTOR_0201  [0201]
R36924  10K  RESISTOR_0201  [0201]
R36925  10K  RESISTOR_0201  [0201]
R36926  10K  RESISTOR_0201  [0201]
R36927  10K  RESISTOR_0201  [0201]
R36928  10K  RESISTOR_0201  [0201]
R36929  10K  RESISTOR_0201  [0201]
R36930  10K  RESISTOR_0201  [0201]
R36931  10K  RESISTOR_0201  [0201]
R36932  10K  RESISTOR_0201  [0201]
R36933  10K  RESISTOR_0201  [0201]
R36934  10K  RESISTOR_0201  [0201]
R36935  10K  RESISTOR_0201  [0201]
R36936  10K  RESISTOR_0201  [0201]
R36937  10K  RESISTOR_0201  [0201]
R36938  10K  RESISTOR_0201  [0201]
R36939  10K  RESISTOR_0201  [0201]
R36940  10K  RESISTOR_0201  [0201]
R36941  10K  RESISTOR_0201  [0201]
R36942  10K  RESISTOR_0201  [0201]
R36943  10K  RESISTOR_0201  [0201]
R36944  10K  RESISTOR_0201  [0201]
R36945  10K  RESISTOR_0201  [0201]
R36946  10K  RESISTOR_0201  [0201]
R36947  10K  RESISTOR_0201  [0201]
R36948  10K  RESISTOR_0201  [0201]
R36949  10K  RESISTOR_0201  [0201]
R36950  10K  RESISTOR_0201  [0201]
R36951  10K  RESISTOR_0201  [0201]
R36952  10K  RESISTOR_0201  [0201]
R36953  10K  RESISTOR_0201  [0201]
R36954  10K  RESISTOR_0201  [0201]
R36955  10K  RESISTOR_0201  [0201]
R36956  10K  RESISTOR_0201  [0201]
R36957  10K  RESISTOR_0201  [0201]
R36958  10K  RESISTOR_0201  [0201]
R36959  10K  RESISTOR_0201  [0201]
R36960  10K  RESISTOR_0201  [0201]
R36961  10K  RESISTOR_0201  [0201]
R36962  10K  RESISTOR_0201  [0201]
R36963  10K  RESISTOR_0201  [0201]
R36964  10K  RESISTOR_0201  [0201]
R36965  10K  RESISTOR_0201  [0201]
R36966  10K  RESISTOR_0201  [0201]
R36967  10K  RESISTOR_0201  [0201]
R36968  10K  RESISTOR_0201  [0201]
R36969  10K  RESISTOR_0201  [0201]
R36970  10K  RESISTOR_0201  [0201]
R36971  10K  RESISTOR_0201  [0201]
R36972  10K  RESISTOR_0201  [0201]
R36973  10K  RESISTOR_0201  [0201]
R36974  10K  RESISTOR_0201  [0201]
R36975  10K  RESISTOR_0201  [0201]
R36976  10K  RESISTOR_0201  [0201]
R36977  10K  RESISTOR_0201  [0201]
R36978  10K  RESISTOR_0201  [0201]
R36979  10K  RESISTOR_0201  [0201]
R36980  10K  RESISTOR_0201  [0201]
R36981  10K  RESISTOR_0201  [0201]
R36982  10K  RESISTOR_0201  [0201]
R36983  10K  RESISTOR_0201  [0201]
R36984  10K  RESISTOR_0201  [0201]
R36985  10K  RESISTOR_0201  [0201]
R36986  10K  RESISTOR_0201  [0201]
R36987  10K  RESISTOR_0201  [0201]
R36988  10K  RESISTOR_0201  [0201]
R36989  10K  RESISTOR_0201  [0201]
R36990  10K  RESISTOR_0201  [0201]
R36991  10K  RESISTOR_0201  [0201]
R36992  10K  RESISTOR_0201  [0201]
R36993  10K  RESISTOR_0201  [0201]
R36994  10K  RESISTOR_0201  [0201]
R36995  10K  RESISTOR_0201  [0201]
R36996  10K  RESISTOR_0201  [0201]
R36997  10K  RESISTOR_0201  [0201]
R36998  10K  RESISTOR_0201  [0201]
R36999  10K  RESISTOR_0201  [0201]
R37000  10K  RESISTOR_0201  [0201]
R37001  10K  RESISTOR_0201  [0201]
R37002  10K  RESISTOR_0201  [0201]
R37003  10K  RESISTOR_0201  [0201]
R37004  10K  RESISTOR_0201  [0201]
R37005  10K  RESISTOR_0201  [0201]
R37006  10K  RESISTOR_0201  [0201]
R37007  10K  RESISTOR_0201  [0201]
R37008  10K  RESISTOR_0201  [0201]
R37009  10K  RESISTOR_0201  [0201]
R37010  10K  RESISTOR_0201  [0201]
R37011  10K  RESISTOR_0201  [0201]
R37012  10K  RESISTOR_0201  [0201]
R37013  10K  RESISTOR_0201  [0201]
R37014  10K  RESISTOR_0201  [0201]
R37015  10K  RESISTOR_0201  [0201]
R37016  10K  RESISTOR_0201  [0201]
R37017  10K  RESISTOR_0201  [0201]
R37018  10K  RESISTOR_0201  [0201]
R37019  10K  RESISTOR_0201  [0201]
R37020  10K  RESISTOR_0201  [0201]
R37021  10K  RESISTOR_0201  [0201]
R37022  10K  RESISTOR_0201  [0201]
R37023  10K  RESISTOR_0201  [0201]
R37024  10K  RESISTOR_0201  [0201]
R37025  10K  RESISTOR_0201  [0201]
R37026  10K  RESISTOR_0201  [0201]
R37027  10K  RESISTOR_0201  [0201]
R37028  10K  RESISTOR_0201  [0201]
R37029  10K  RESISTOR_0201  [0201]
R37030  10K  RESISTOR_0201  [0201]
R37031  10K  RESISTOR_0201  [0201]
R37032  10K  RESISTOR_0201  [0201]
R37033  10K  RESISTOR_0201  [0201]
R37034  10K  RESISTOR_0201  [0201]
R37035  10K  RESISTOR_0201  [0201]
R37036  10K  RESISTOR_0201  [0201]
R37037  10K  RESISTOR_0201  [0201]
R37038  10K  RESISTOR_0201  [0201]
R37039  10K  RESISTOR_0201  [0201]
R37040  10K  RESISTOR_0201  [0201]
R37041  10K  RESISTOR_0201  [0201]
R37042  10K  RESISTOR_0201  [0201]
R37043  10K  RESISTOR_0201  [0201]
R37044  10K  RESISTOR_0201  [0201]
R37045  10K  RESISTOR_0201  [0201]
R37046  10K  RESISTOR_0201  [0201]
R37047  10K  RESISTOR_0201  [0201]
R37048  10K  RESISTOR_0201  [0201]
R37049  10K  RESISTOR_0201  [0201]
R37050  10K  RESISTOR_0201  [0201]
R37051  10K  RESISTOR_0201  [0201]
R37052  10K  RESISTOR_0201  [0201]
R37053  10K  RESISTOR_0201  [0201]
R37054  10K  RESISTOR_0201  [0201]
R37055  10K  RESISTOR_0201  [0201]
R37056  10K  RESISTOR_0201  [0201]
R37057  10K  RESISTOR_0201  [0201]
R37058  10K  RESISTOR_0201  [0201]
R37059  10K  RESISTOR_0201  [0201]
R37060  10K  RESISTOR_0201  [0201]
R37061  10K  RESISTOR_0201  [0201]
R37062  10K  RESISTOR_0201  [0201]
R37063  10K  RESISTOR_0201  [0201]
R37064  10K  RESISTOR_0201  [0201]
R37065  10K  RESISTOR_0201  [0201]
R37066  10K  RESISTOR_0201  [0201]
R37067  10K  RESISTOR_0201  [0201]
R37068  10K  RESISTOR_0201  [0201]
R37069  10K  RESISTOR_0201  [0201]
R37070  10K  RESISTOR_0201  [0201]
R37071  10K  RESISTOR_0201  [0201]
R37072  10K  RESISTOR_0201  [0201]
R37073  10K  RESISTOR_0201  [0201]
R37074  10K  RESISTOR_0201  [0201]
R37075  10K  RESISTOR_0201  [0201]
R37076  10K  RESISTOR_0201  [0201]
R37077  10K  RESISTOR_0201  [0201]
R37078  10K  RESISTOR_0201  [0201]
R37079  10K  RESISTOR_0201  [0201]
R37080  10K  RESISTOR_0201  [0201]
R37081  10K  RESISTOR_0201  [0201]
R37082  10K  RESISTOR_0201  [0201]
R37083  10K  RESISTOR_0201  [0201]
R37084  10K  RESISTOR_0201  [0201]
R37085  10K  RESISTOR_0201  [0201]
R37086  10K  RESISTOR_0201  [0201]
R37087  10K  RESISTOR_0201  [0201]
R37088  10K  RESISTOR_0201  [0201]
R37089  10K  RESISTOR_0201  [0201]
R37090  10K  RESISTOR_0201  [0201]
R37091  10K  RESISTOR_0201  [0201]
R37092  10K  RESISTOR_0201  [0201]
R37093  10K  RESISTOR_0201  [0201]
R37094  10K  RESISTOR_0201  [0201]
R37095  10K  RESISTOR_0201  [0201]
R37096  10K  RESISTOR_0201  [0201]
R37097  10K  RESISTOR_0201  [0201]
R37098  10K  RESISTOR_0201  [0201]
R37099  10K  RESISTOR_0201  [0201]
R37100  10K  RESISTOR_0201  [0201]
R37101  10K  RESISTOR_0201  [0201]
R37102  10K  RESISTOR_0201  [0201]
R37103  10K  RESISTOR_0201  [0201]
R37104  10K  RESISTOR_0201  [0201]
R37105  10K  RESISTOR_0201  [0201]
R37106  10K  RESISTOR_0201  [0201]
R37107  10K  RESISTOR_0201  [0201]
R37108  10K  RESISTOR_0201  [0201]
R37109  10K  RESISTOR_0201  [0201]
R37110  10K  RESISTOR_0201  [0201]
R37111  10K  RESISTOR_0201  [0201]
R37112  10K  RESISTOR_0201  [0201]
R37113  10K  RESISTOR_0201  [0201]
R37114  10K  RESISTOR_0201  [0201]
R37115  10K  RESISTOR_0201  [0201]
R37116  10K  RESISTOR_0201  [0201]
R37117  10K  RESISTOR_0201  [0201]
R37118  10K  RESISTOR_0201  [0201]
R37119  10K  RESISTOR_0201  [0201]
R37120  10K  RESISTOR_0201  [0201]
R37121  10K  RESISTOR_0201  [0201]
R37122  10K  RESISTOR_0201  [0201]
R37123  10K  RESISTOR_0201  [0201]
R37124  10K  RESISTOR_0201  [0201]
R37125  10K  RESISTOR_0201  [0201]
R37126  10K  RESISTOR_0201  [0201]
R37127  10K  RESISTOR_0201  [0201]
R37128  10K  RESISTOR_0201  [0201]
R37129  10K  RESISTOR_0201  [0201]
R37130  10K  RESISTOR_0201  [0201]
R37131  10K  RESISTOR_0201  [0201]
R37132  10K  RESISTOR_0201  [0201]
R37133  10K  RESISTOR_0201  [0201]
R37134  10K  RESISTOR_0201  [0201]
R37135  10K  RESISTOR_0201  [0201]
R37136  10K  RESISTOR_0201  [0201]
R37137  10K  RESISTOR_0201  [0201]
R37138  10K  RESISTOR_0201  [0201]
R37139  10K  RESISTOR_0201  [0201]
R37140  10K  RESISTOR_0201  [0201]
R37141  10K  RESISTOR_0201  [0201]
R37142  10K  RESISTOR_0201  [0201]
R37143  10K  RESISTOR_0201  [0201]
R37144  10K  RESISTOR_0201  [0201]
R37145  10K  RESISTOR_0201  [0201]
R37146  10K  RESISTOR_0201  [0201]
R37147  10K  RESISTOR_0201  [0201]
R37148  10K  RESISTOR_0201  [0201]
R37149  10K  RESISTOR_0201  [0201]
R37150  10K  RESISTOR_0201  [0201]
R37151  10K  RESISTOR_0201  [0201]
R37152  10K  RESISTOR_0201  [0201]
R37153  10K  RESISTOR_0201  [0201]
R37154  10K  RESISTOR_0201  [0201]
R37155  10K  RESISTOR_0201  [0201]
R37156  10K  RESISTOR_0201  [0201]
R37157  10K  RESISTOR_0201  [0201]
R37158  10K  RESISTOR_0201  [0201]
R37159  10K  RESISTOR_0201  [0201]
R37160  10K  RESISTOR_0201  [0201]
R37161  10K  RESISTOR_0201  [0201]
R37162  10K  RESISTOR_0201  [0201]
R37163  10K  RESISTOR_0201  [0201]
R37164  10K  RESISTOR_0201  [0201]
R37165  10K  RESISTOR_0201  [0201]
R37166  10K  RESISTOR_0201  [0201]
R37167  10K  RESISTOR_0201  [0201]
R37168  10K  RESISTOR_0201  [0201]
R37169  10K  RESISTOR_0201  [0201]
R37170  10K  RESISTOR_0201  [0201]
R37171  10K  RESISTOR_0201  [0201]
R37172  10K  RESISTOR_0201  [0201]
R37173  10K  RESISTOR_0201  [0201]
R37174  10K  RESISTOR_0201  [0201]
R37175  10K  RESISTOR_0201  [0201]
R37176  10K  RESISTOR_0201  [0201]
R37177  10K  RESISTOR_0201  [0201]
R37178  10K  RESISTOR_0201  [0201]
R37179  10K  RESISTOR_0201  [0201]
R37180  10K  RESISTOR_0201  [0201]
R37181  10K  RESISTOR_0201  [0201]
R37182  10K  RESISTOR_0201  [0201]
R37183  10K  RESISTOR_0201  [0201]
R37184  10K  RESISTOR_0201  [0201]
R37185  10K  RESISTOR_0201  [0201]
R37186  10K  RESISTOR_0201  [0201]
R37187  10K  RESISTOR_0201  [0201]
R37188  10K  RESISTOR_0201  [0201]
R37189  10K  RESISTOR_0201  [0201]
R37190  10K  RESISTOR_0201  [0201]
R37191  10K  RESISTOR_0201  [0201]
R37192  10K  RESISTOR_0201  [0201]
R37193  10K  RESISTOR_0201  [0201]
R37194  10K  RESISTOR_0201  [0201]
R37195  10K  RESISTOR_0201  [0201]
R37196  10K  RESISTOR_0201  [0201]
R37197  10K  RESISTOR_0201  [0201]
R37198  10K  RESISTOR_0201  [0201]
R37199  10K  RESISTOR_0201  [0201]
R37200  10K  RESISTOR_0201  [0201]
R37201  10K  RESISTOR_0201  [0201]
R37202  10K  RESISTOR_0201  [0201]
R37203  10K  RESISTOR_0201  [0201]
R37204  10K  RESISTOR_0201  [0201]
R37205  10K  RESISTOR_0201  [0201]
R37206  10K  RESISTOR_0201  [0201]
R37207  10K  RESISTOR_0201  [0201]
R37208  10K  RESISTOR_0201  [0201]
R37209  10K  RESISTOR_0201  [0201]
R37210  10K  RESISTOR_0201  [0201]
R37211  10K  RESISTOR_0201  [0201]
R37212  10K  RESISTOR_0201  [0201]
R37213  10K  RESISTOR_0201  [0201]
R37214  10K  RESISTOR_0201  [0201]
R37215  10K  RESISTOR_0201  [0201]
R37216  10K  RESISTOR_0201  [0201]
R37217  10K  RESISTOR_0201  [0201]